# Altium schematic sheet 0228_GPU DDI_ A,B,C,D.SchDoc
size 848 x 558 mm
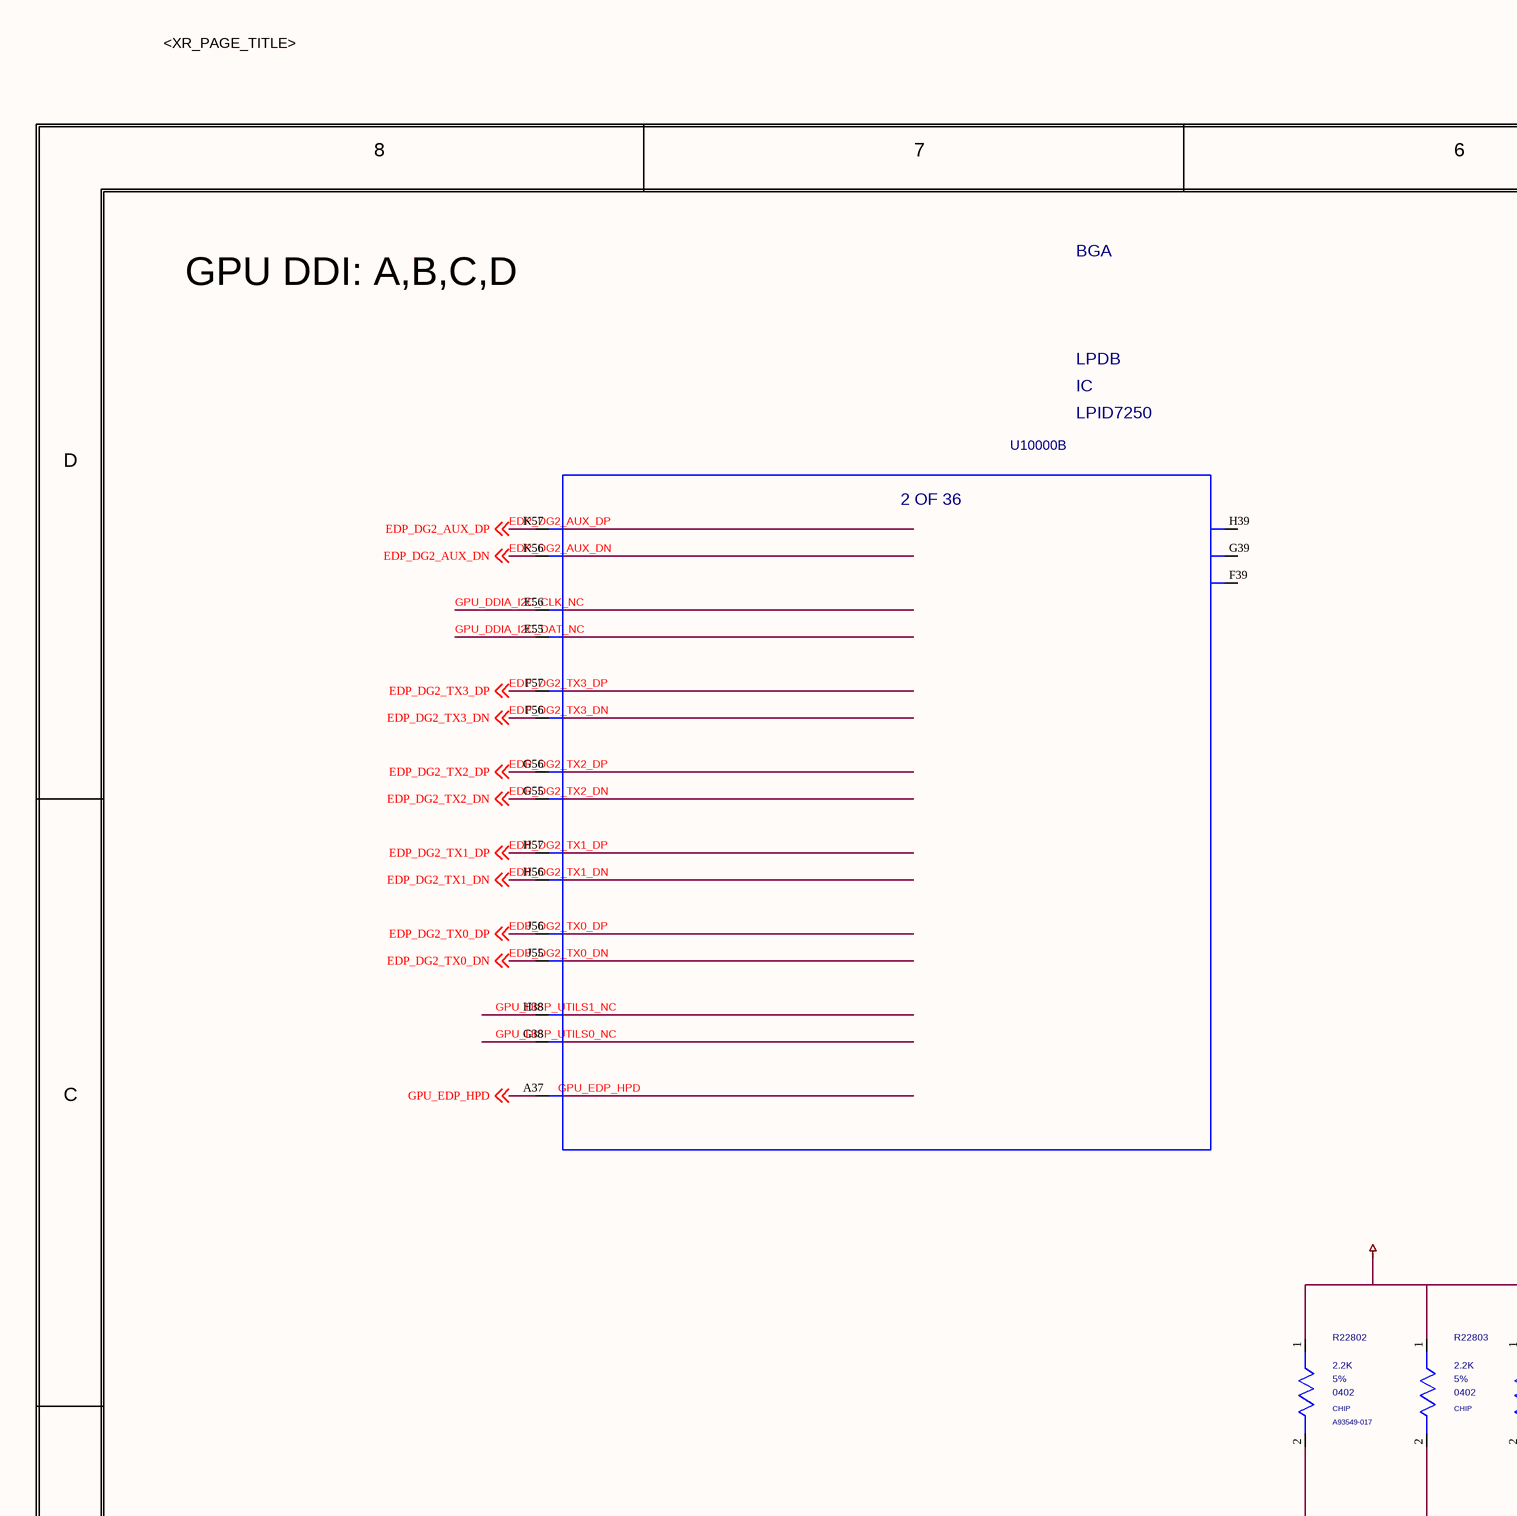
[diagram p0: 0228_GPU DDI_ A,B,C,D.SchDoc, top left]
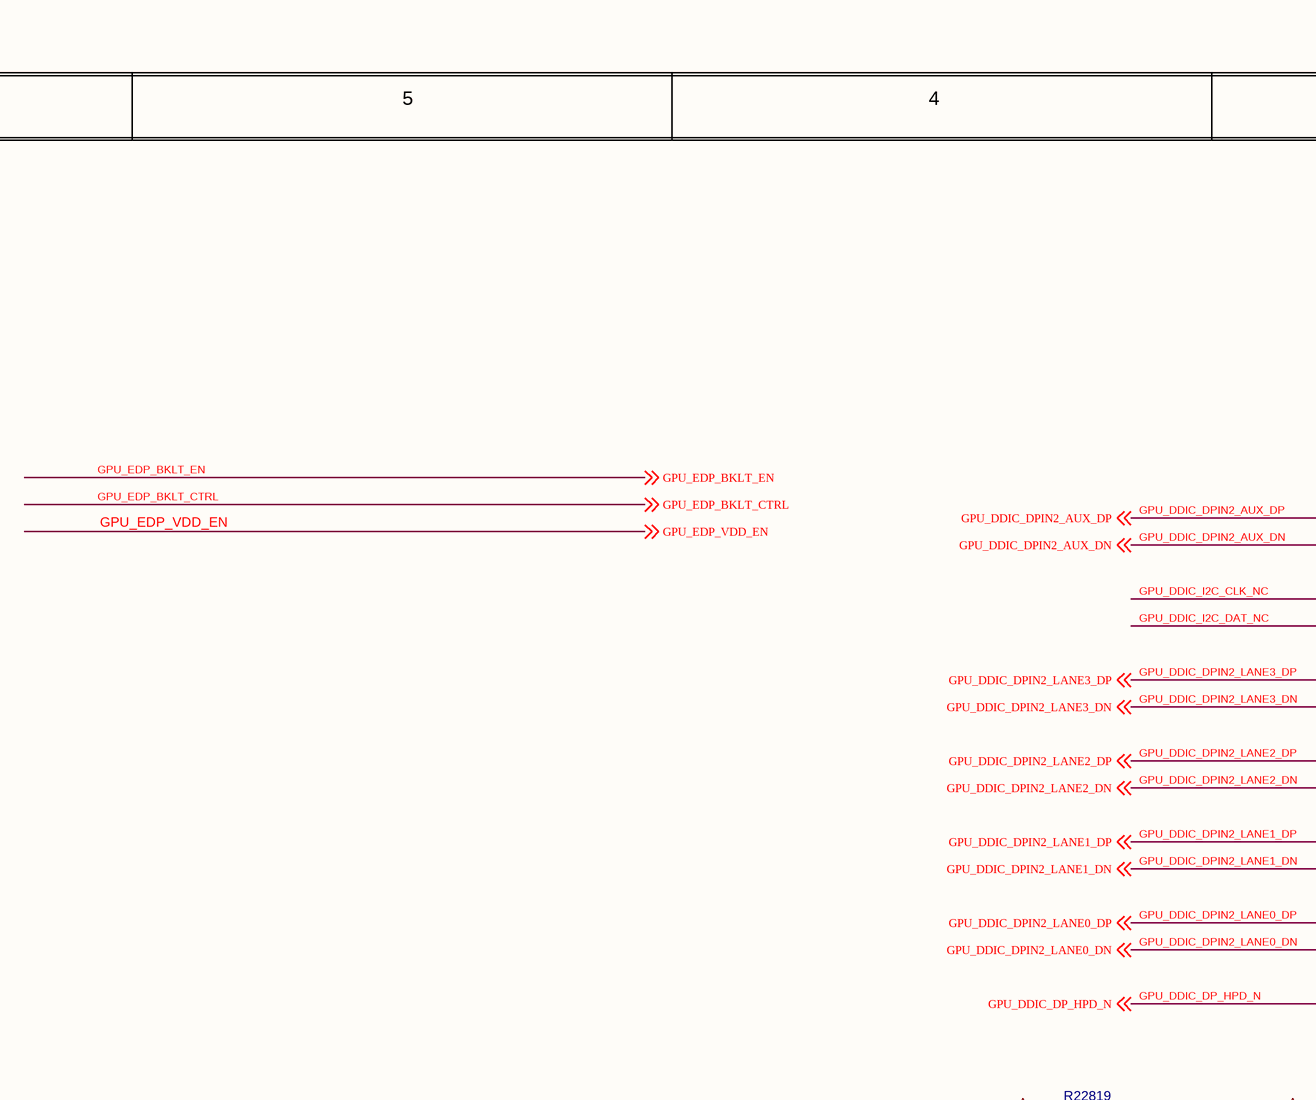
[diagram p1: 0228_GPU DDI_ A,B,C,D.SchDoc, top middle]
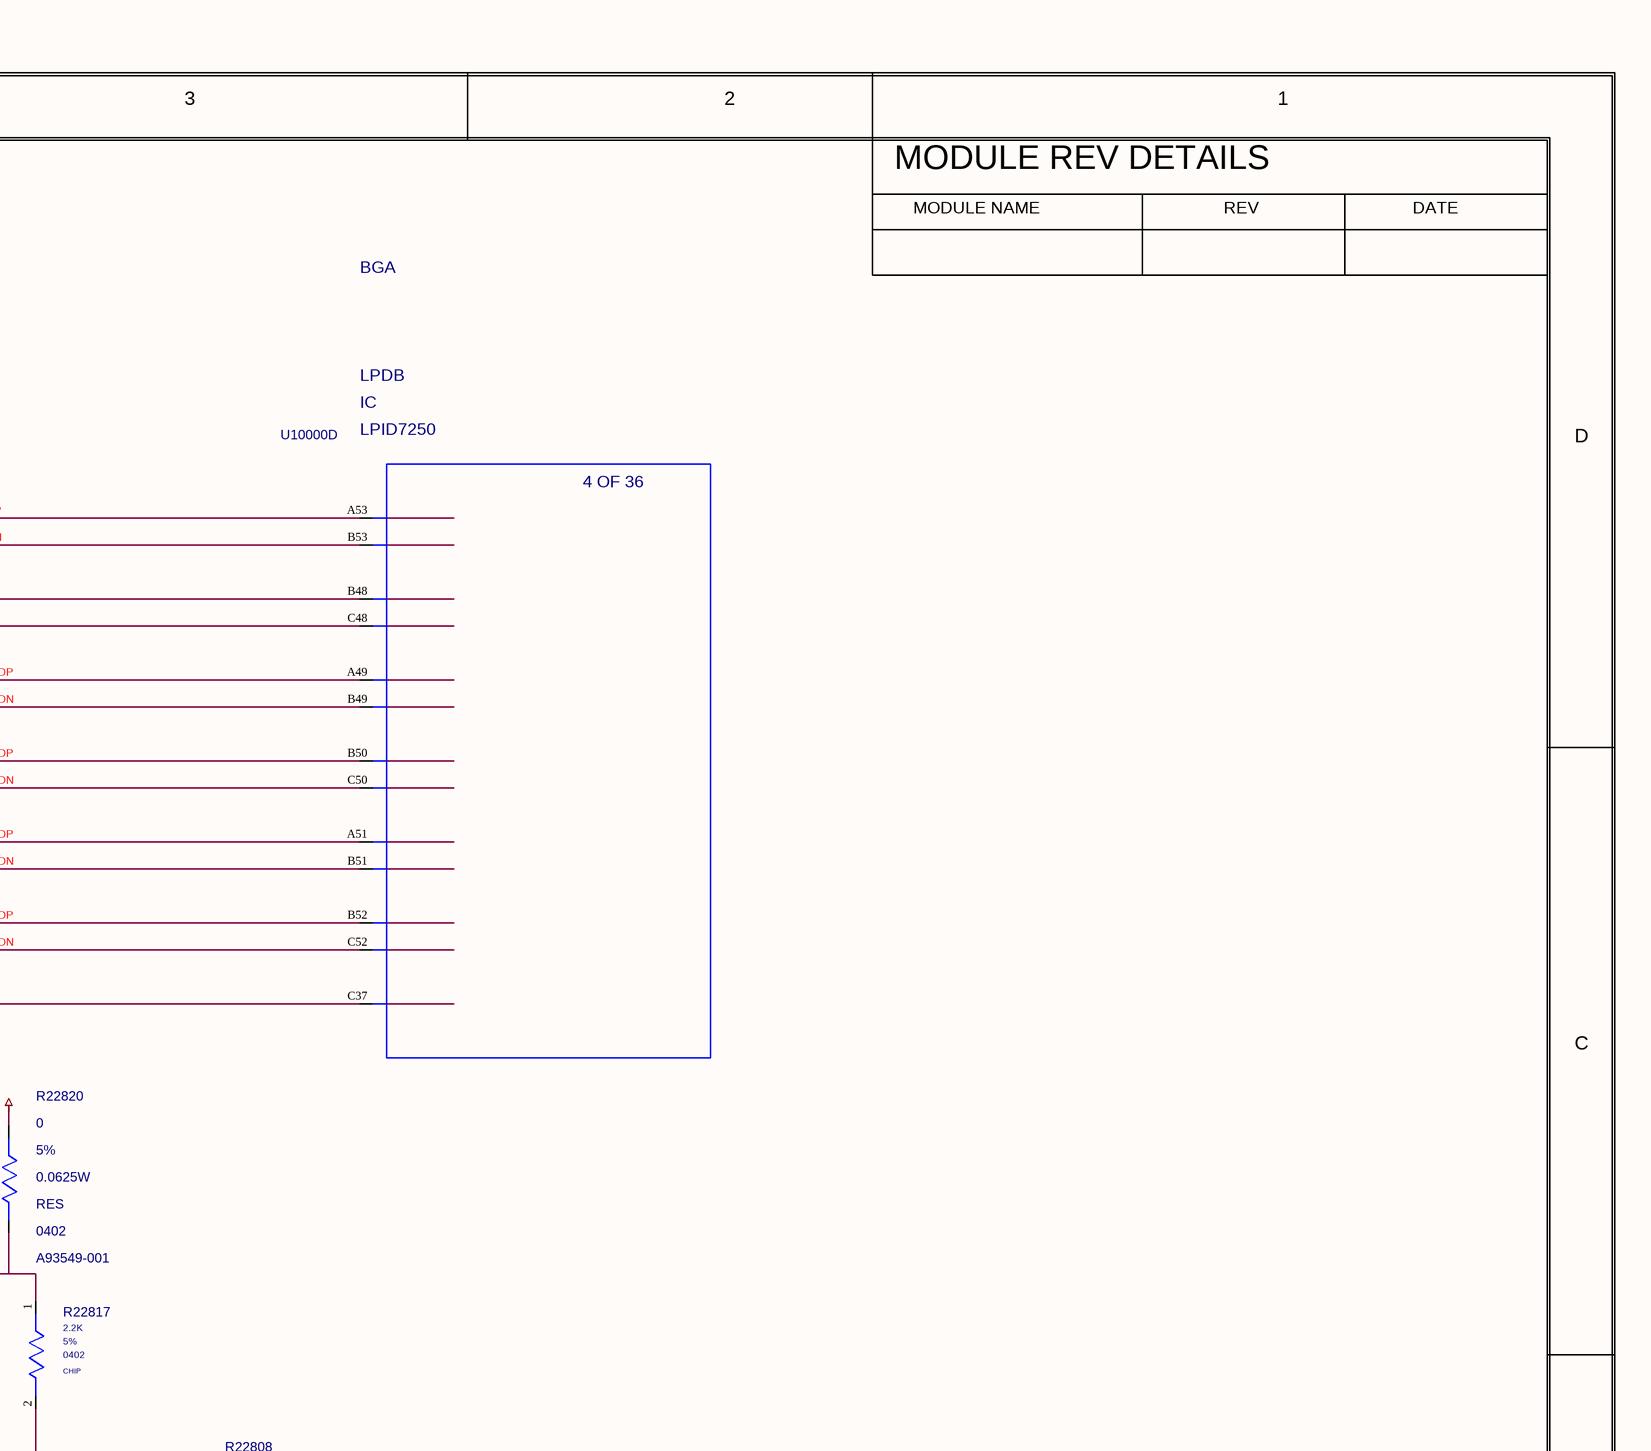
[diagram p2: 0228_GPU DDI_ A,B,C,D.SchDoc, top right]
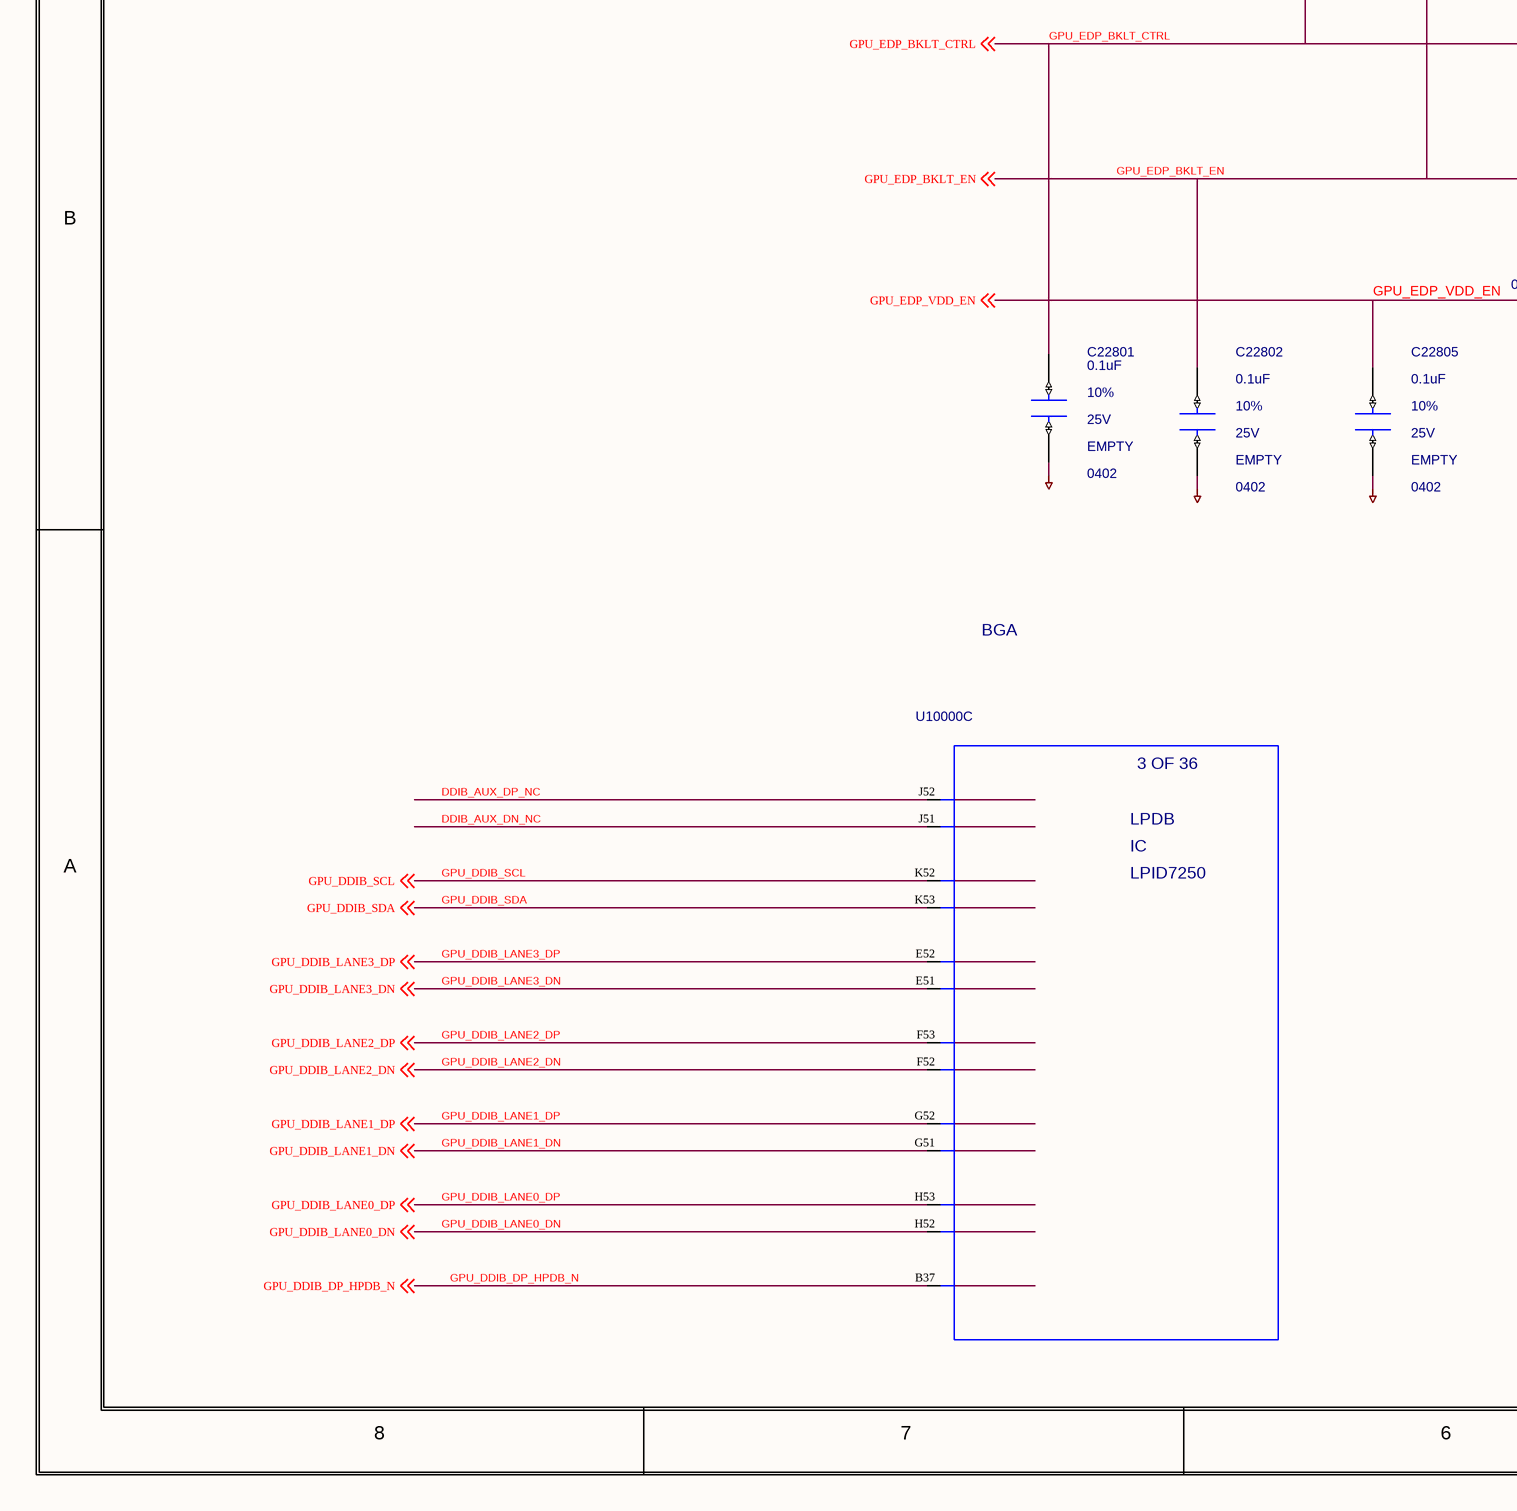
[diagram p3: 0228_GPU DDI_ A,B,C,D.SchDoc, bottom left]
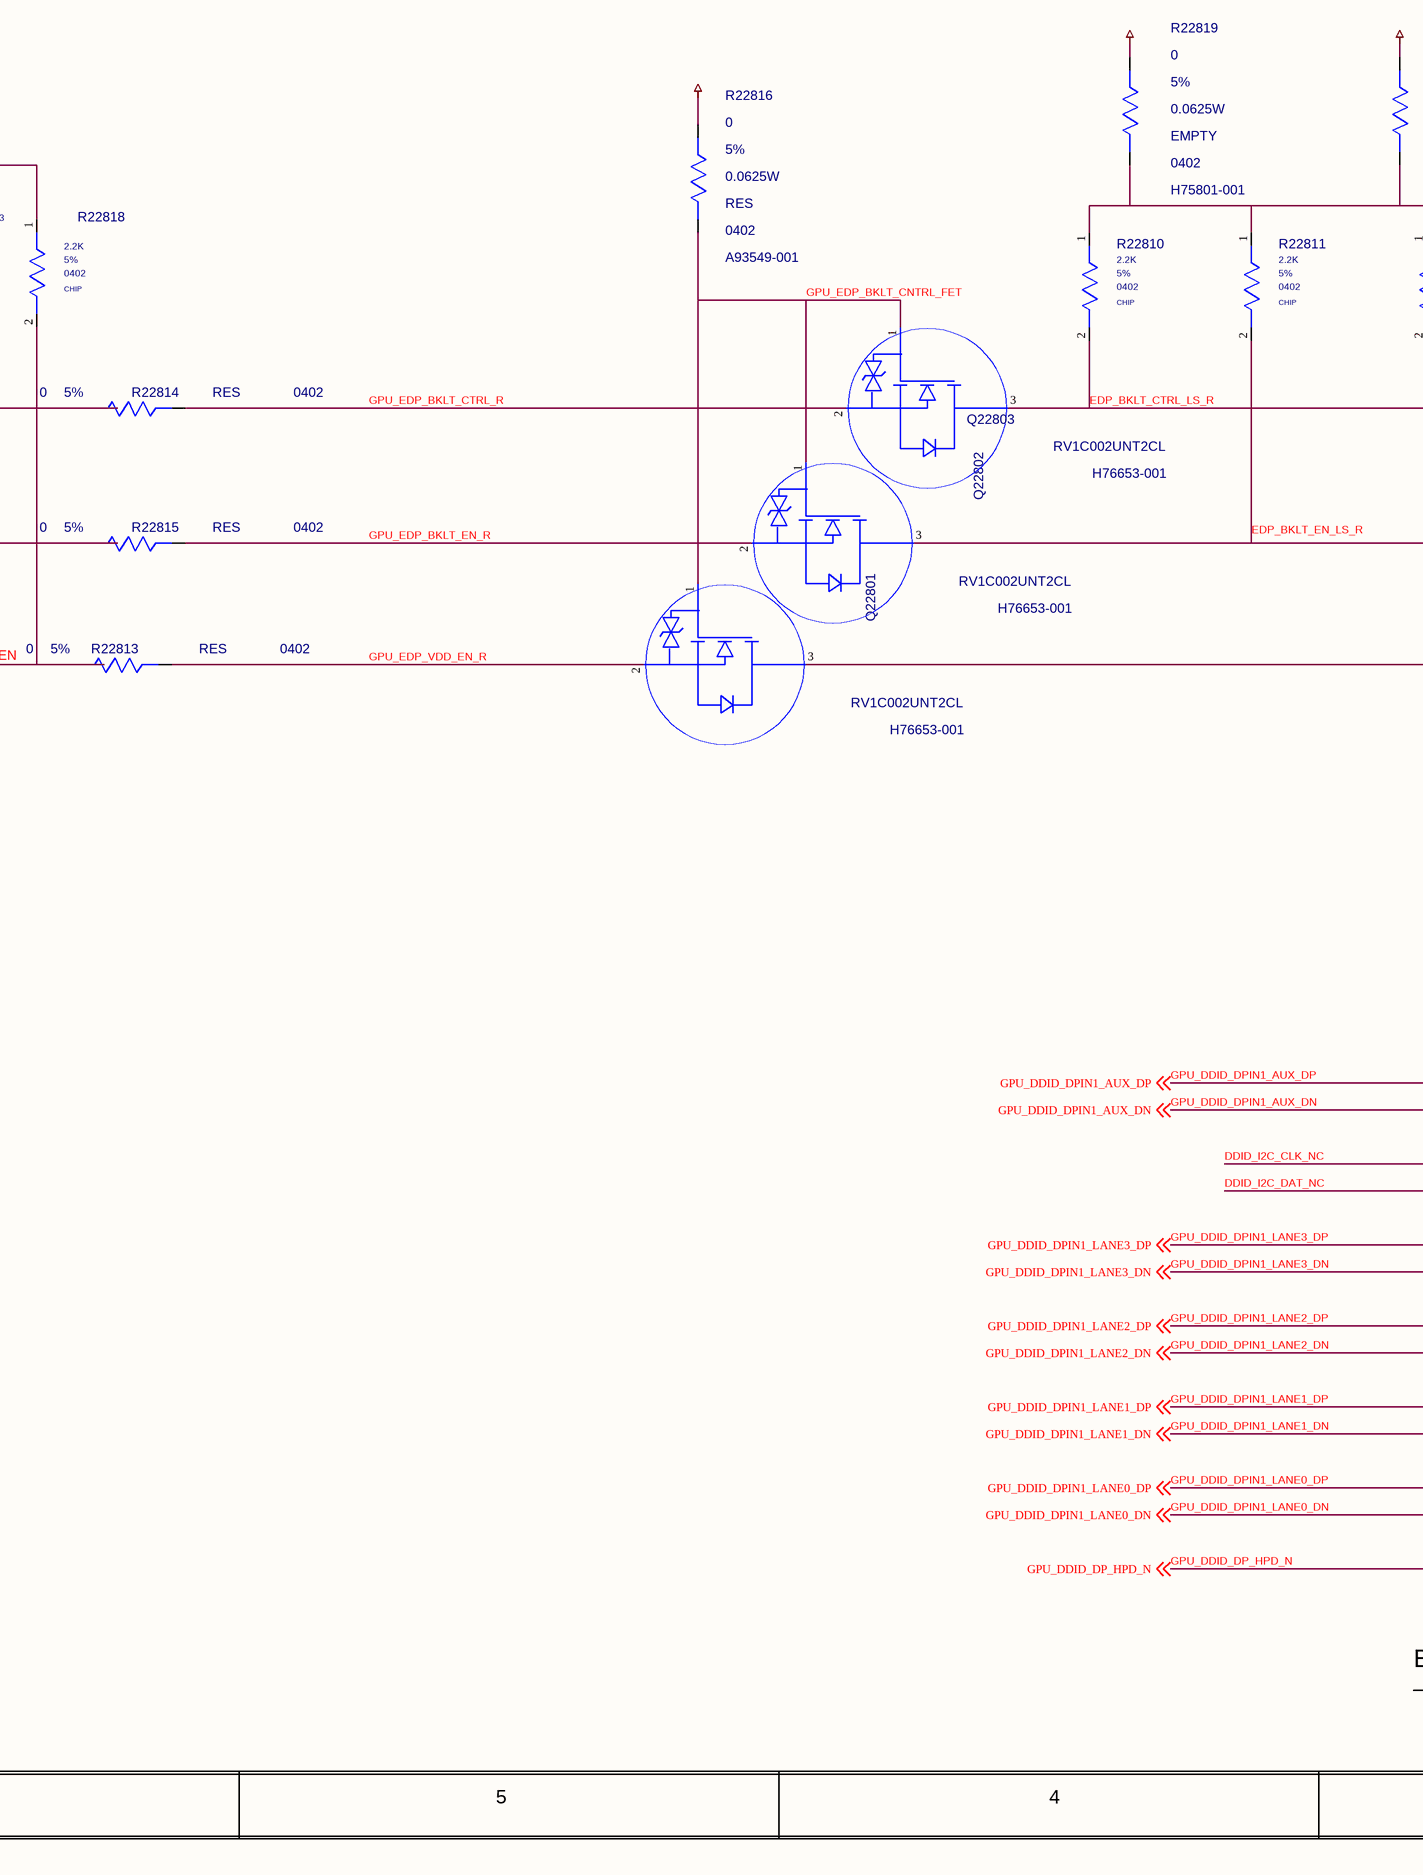
[diagram p4: 0228_GPU DDI_ A,B,C,D.SchDoc, bottom middle]